# EasyEDA Pro project FPGA-G1.eprj, board logi Pi (continued)
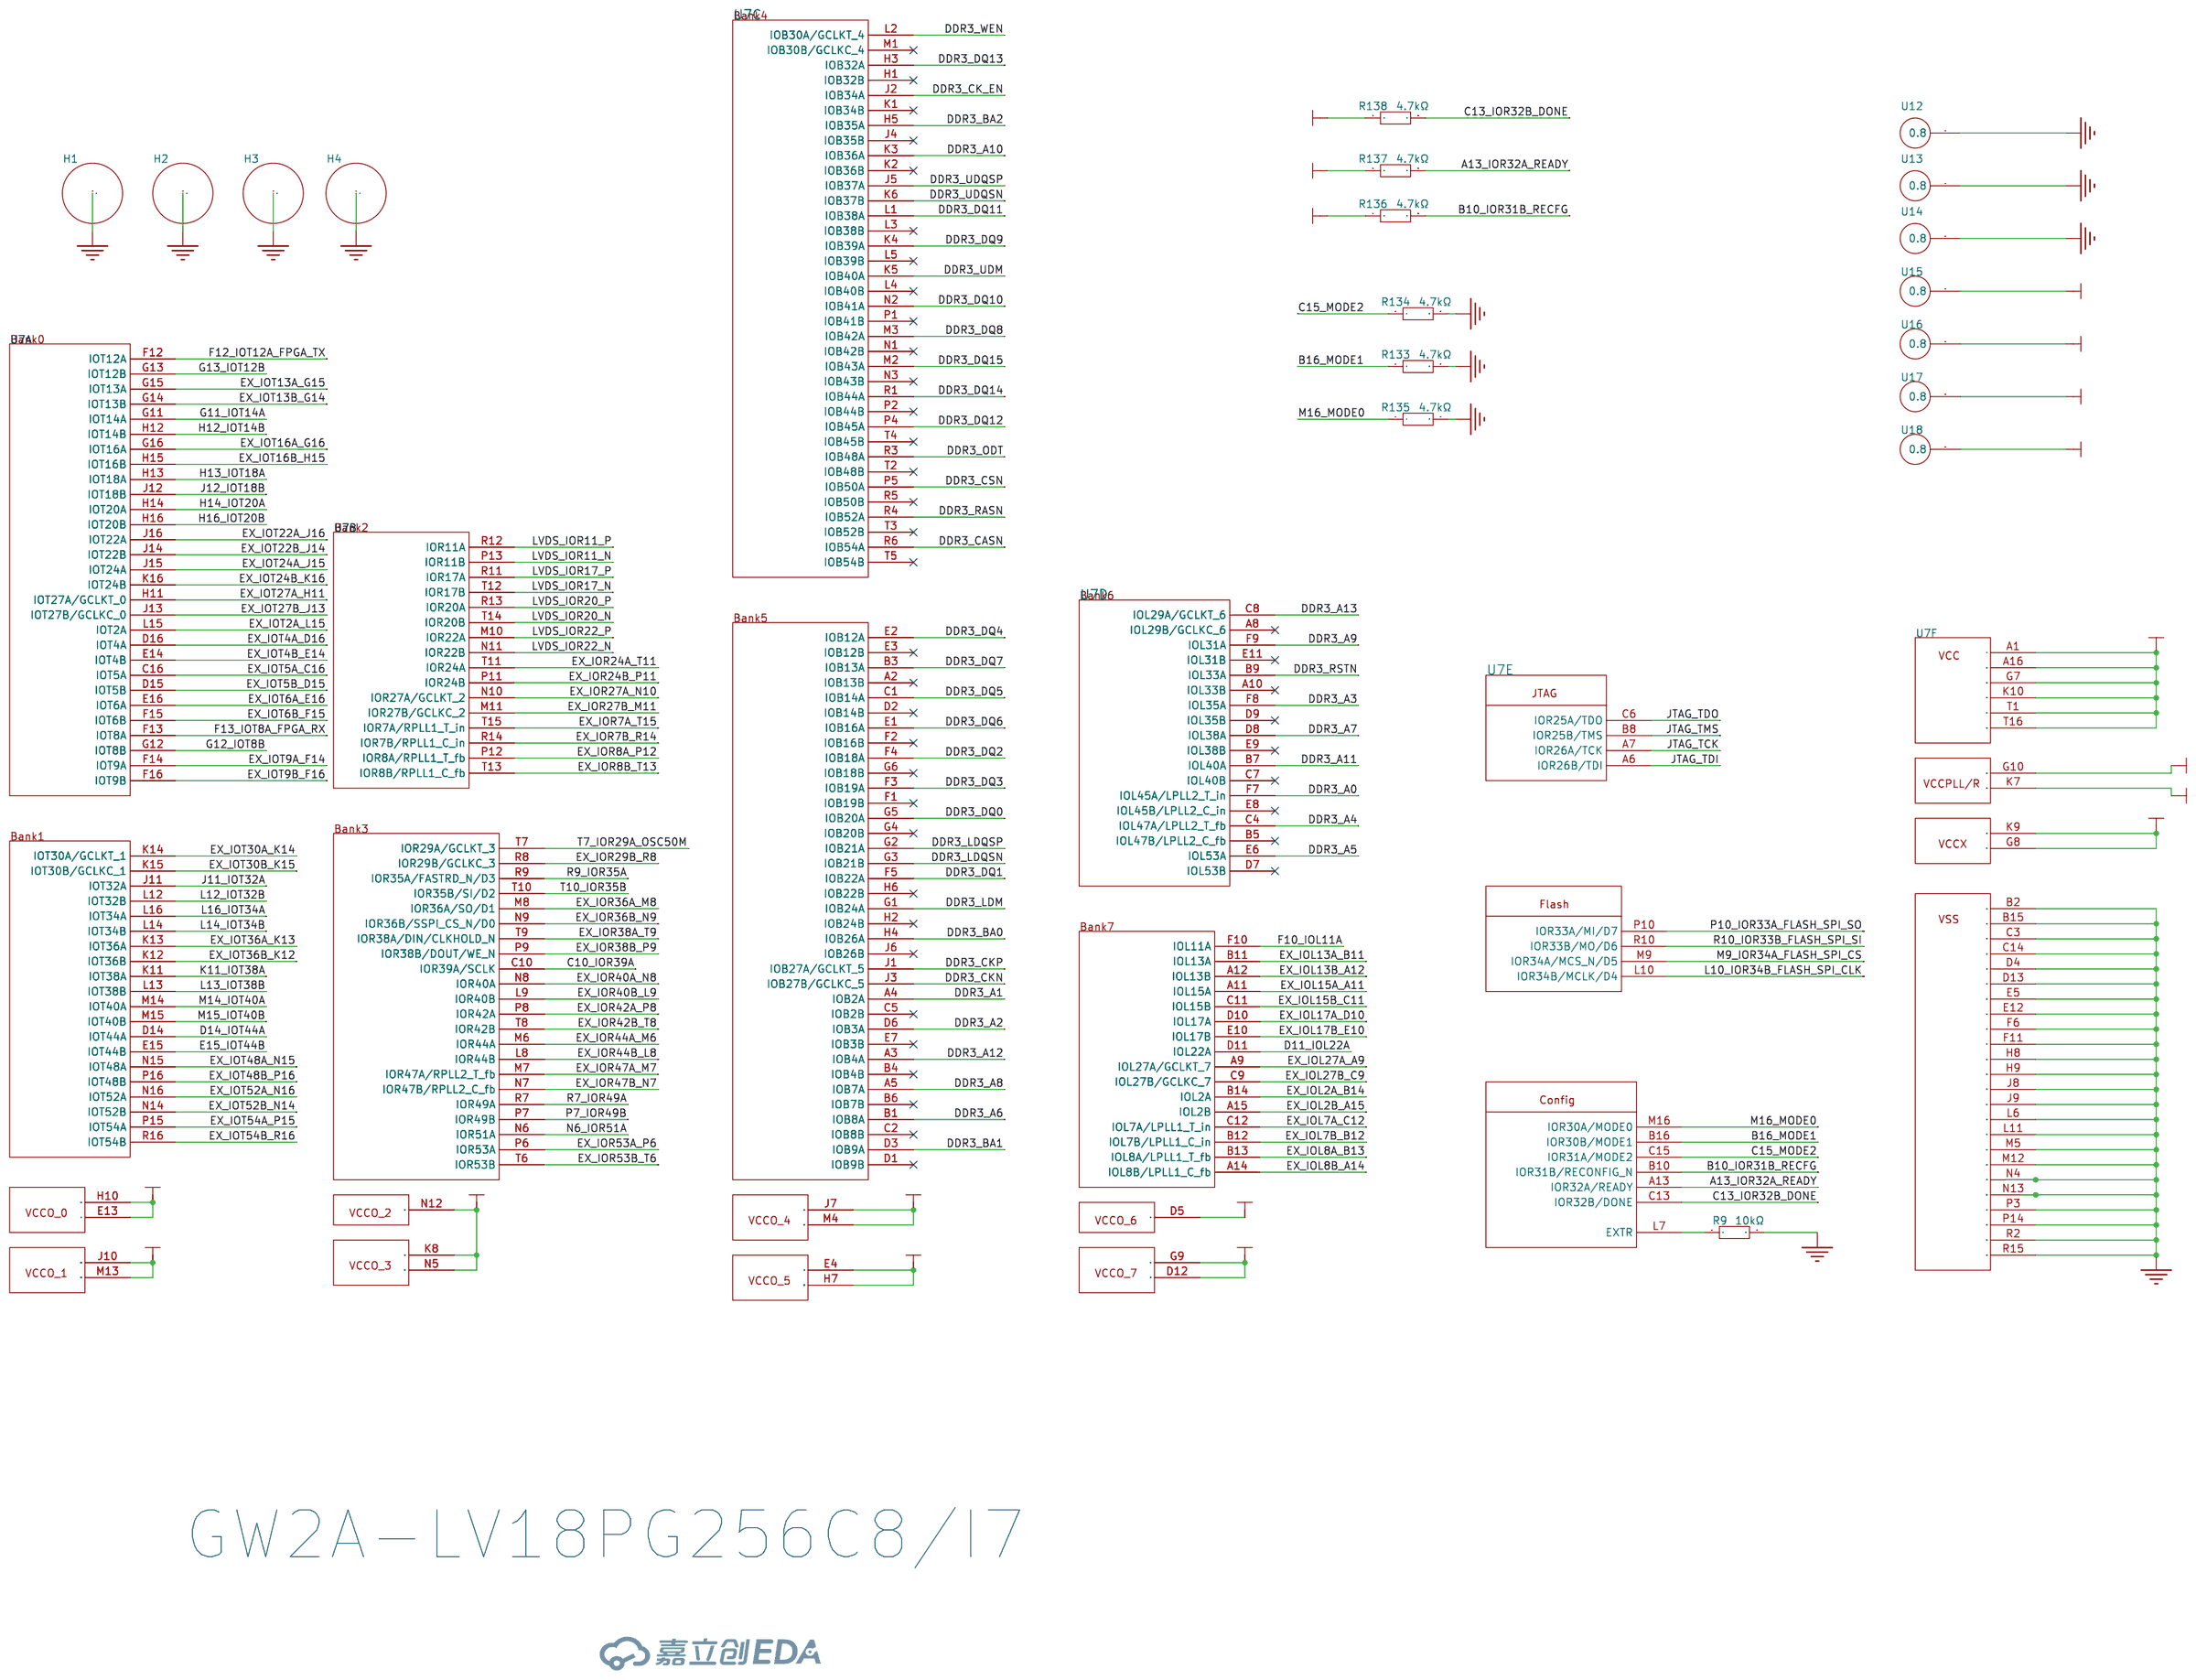
[diagram p0: FPGA]
## Routing (per net, layer and track width the routed paths; a pad name or vN(x,y) marks a point on that pad's centre or on a via; arc(x,y) is an arc through that point) (continued)
P10_IOR33A_FLASH_SPI_SO: length 9.8
  Top Layer w0.109: 28.33,23.89 27.78,23.33 v1(27.22,23.33) ; 29.2,30.58 28.7,30.08
  Bottom Layer w0.109: v1(27.22,23.33) 27.84,23.33 28.18,23.68 28.18,29.19 28.71,29.71 v1(28.71,30.08)
PA8: length 75.1
  Top Layer w0.109: 32.42,18.63 33.29,18.63 33.69,18.23 ; 30.92,59.83 30.84,59.76 30.84,58.91 v1(31.08,58.67) ; 33.62,13.88 33.26,14.24 32.37,14.24 ; 32.33,14.24 31.97,14.24 31.66,14.55 31.66,16.25 31.84,16.43 ; 32.33,16.46 31.88,16.46 31.84,16.43 ; 31.84,16.43 31.81,16.43 31.65,16.58 31.65,18.45 31.84,18.64 32.25,18.64 ; C172.2 37.62,16.46 38.1,15.98 42.24,15.98 42.78,16.51 42.78,18.22 v1(42.33,18.66)
  SIG04 w0.109: v1(42.33,18.66) 42.33,18.75 43.02,19.44 43.02,25.78 44.19,26.94 44.19,34.95 42.83,36.31 42.83,56.29 42.19,56.93 38.08,56.93 37.3,57.71 32.05,57.71 v1(31.08,58.67)
PA9/USART0_TX: length 6.3
  Top Layer w0.109: 30.33,59.96 v1(30.33,59.29)
  Bottom Layer w0.109: v1(30.33,59.29) 30.33,63.06 29.1,64.29 28.94,64.29
PA10/USART0_RX: length 7.7
  Top Layer w0.109: 29.78,59.91 29.78,59.22 v1(30.33,58.67)
  Bottom Layer w0.109: 30.03,64.38 30.83,63.58 30.83,59.17 v1(30.33,58.67)
PA13/SWDIO: length 15.5
  Top Layer w0.109: 28.35,59.86 28.35,59.41 28.12,59.19 26.9,59.19 26.69,59.4 26.69,61.95 26.56,62.08 25.85,62.08
  Bottom Layer w0.109: 31.96,64.91 31.96,65.97 31.49,66.44 28.45,66.44 27.13,65.12 27.13,63.89 v1(25.82,62.57)
PA14/SWCLK: length 15.5
  Top Layer w0.109: 26.11,60.52 26.19,60.6 26.47,60.31 26.47,59.11 26.31,58.94
  Bottom Layer w0.109: 25.75,61.28 25.25,61.79 25.25,63.95 28.26,66.96 32.47,66.96 33.14,66.3 33.14,65.04
  vias: v1(25.82,61.27)
PA15/SPI2_NSS: length 28.1
  Top Layer w0.109: 25.25,58.45 25.19,58.51 18.05,58.51 15.28,55.74 13.2,55.74 12.24,54.78 12.24,50.46 12.67,50.02 13.98,50.02 14.31,50.36
  Bottom Layer w0.109: 18.15,54.53 18.15,53.73 17.38,52.96 15.45,52.96 ; 14.41,50.36 15.26,50.36 15.46,50.56 15.46,51.71 15.46,51.72 ; 15.44,52.63 15.44,51.96 15.45,51.95
  vias: v1(14.42,50.4)
PB3/SPI2_SCK: length 27.7
  Top Layer w0.109: 25.45,57.95 24.51,57.95 24.32,58.15 18.26,58.15 15.17,55.06 14.66,55.06 14.59,55.13 14.59,55.3 14.51,55.38 14.34,55.38 14.26,55.3 14.26,55.13 14.18,55.06 14.01,55.06 13.93,55.13 13.93,55.3 13.85,55.38 13.68,55.38 13.6,55.3 13.6,55.13 13.53,55.06 12.98,55.06 12.72,54.8 12.72,54.47 12.8,54.39 13.12,54.39 13.19,54.31 13.19,54.14 13.12,54.06 12.8,54.06 12.72,53.99 12.72,53.81 12.8,53.74 13.12,53.74 13.19,53.66 13.19,53.49 13.12,53.41 12.8,53.41 12.72,53.33 12.72,53.16 12.8,53.08 13.12,53.08 13.19,53 13.19,52.83 13.12,52.75 12.8,52.75 12.72,52.68 12.72,52.5 12.8,52.43 13.12,52.43 13.19,52.35 13.19,52.18 13.12,52.1 12.8,52.1 12.72,52.02 12.72,51.85 12.8,51.77 13.12,51.77 13.19,51.69 13.19,51.52 13.12,51.44 12.8,51.44 12.72,51.37 12.72,50.74 13.05,50.41 v1(13.44,50.41)
  Bottom Layer w0.109: 13.93,52.58 13.93,51.94 13.96,51.91 ; 13.92,51.65 13.92,50.89 v1(13.44,50.41) ; 13.92,52.89 13.93,52.9 13.93,53.14 14.71,53.92 14.71,54.32
PB4/SPI2_MISO: length 27.5
  Top Layer w0.109: 25.43,57.47 24.35,57.47 24.06,57.76 18.6,57.76 15.41,54.56 13.86,54.56 13.55,54.26 13.55,53.87 13.63,53.8 14.45,53.8 14.52,53.72 14.52,53.54 14.45,53.47 13.63,53.47 13.55,53.39 13.55,53.22 13.63,53.14 14.45,53.14 14.52,53.06 14.52,52.89 14.45,52.81 13.63,52.81 13.55,52.74 13.55,52.56 13.63,52.48 14.45,52.48 14.52,52.41 14.52,52.23 14.45,52.16 13.63,52.16 13.55,52.08 13.55,51.91 13.63,51.83 14.45,51.83 14.52,51.75 14.52,51.58 14.45,51.5 13.63,51.5 13.55,51.42 13.55,51.21 v1(13.43,51.08)
  Bottom Layer w0.109: 13.43,52.57 13.43,51.8 ; 13.42,51.8 13.44,51.78 ; 13.4,52.57 13.44,52.61 13.44,53.12 12.66,53.89 12.66,54.42 ; 13.44,51.68 13.43,51.66 13.43,50.94
PB5/SPI2_MOSI: length 27.1
  Top Layer w0.109: v1(15.07,51.08) 15.46,51.47 15.46,51.64 15.53,51.72 16.43,51.72 16.51,51.8 16.51,51.97 16.43,52.05 15.53,52.05 15.46,52.13 15.46,52.3 15.53,52.38 16.79,52.38 16.87,52.45 16.87,52.63 16.79,52.7 15.53,52.7 15.46,52.78 15.46,52.95 15.53,53.03 16.79,53.03 16.87,53.11 16.87,53.28 16.79,53.36 15.53,53.36 15.46,53.44 15.46,54.04 18.74,57.32 24.03,57.32 24.22,57.14 24.81,57.14 24.98,56.96 U1.41
  Bottom Layer w0.109: v1(15.07,51.08) 14.94,51.22 14.94,51.72 ; 14.94,52.6 14.94,52 14.95,51.99 ; 17.03,54.55 17.03,53.81 ; 17.03,53.81 16.59,53.36 15.07,53.36 14.94,53.23 14.94,52.71 ; 17.03,53.81 17.03,53.8
PB6: length 1.5
  Top Layer w0.203: 23.88,56.61 23.92,56.65 24.44,56.65 24.64,56.46 25.31,56.46
PB7: length 1.4
  Top Layer w0.203: 25.22,55.93 24.47,55.93 24.32,55.78 R167.1
PB8: length 1.8
  Top Layer w0.203: 23.79,54.95 23.8,54.96 25.56,54.96 25.57,54.95
R7_IOR49A: length 12.3
  Top Layer w0.109: 16.45,25.21 v1(16.45,25.64) ; U7.R7 v1(25.7,29.09)
  SIG04 w0.109: v1(16.45,25.64) 18.2,27.39 24.75,27.39 25.7,28.34 v1(25.7,29.09)
R9_IOR35A: length 15.2
  Top Layer w0.109: R170.1 18.34,25.94 18.71,26.31 v1(20.1,26.31) ; 28.72,29.1 28.22,29.6
  SIG04 w0.109: v1(28.72,29.11) 28.63,29.11 27.65,28.12 27.65,25.96 27.4,25.71 27.4,25.7 27.24,25.54 20.87,25.54 v1(20.1,26.31)
R10_IOR33B_FLASH_SPI_SI: length 12.3
  Top Layer w0.109: U7.R10 29.25,29.59 v1(29.73,29.12) ; 33.62,20.74 34.16,21.28 34.56,21.28
  Bottom Layer w0.109: 33.62,20.74 29.68,24.68 29.68,27.22 29.23,27.68 29.23,28.61 v1(29.73,29.12)
  vias: v1(33.66,20.74)
T7_IOR29A_OSC50M: length 2.4
  Top Layer w0.254: 26.24,28.6 25.55,27.91 25.55,26.46
T10_IOR35B: length 12.1
  Top Layer w0.109: U7.T10 29.2,27.79 28.72,27.31 ; 20.1,25.26 v1(20.1,25.64)
  SIG04 w0.109: 28.72,27.31 28.72,26.44 27.43,25.15 20.6,25.15 v1(20.1,25.64)
  vias: v1(28.72,27.33)
VREF_DRAM: length 29.9
  Top Layer w0.254: 10.74,23.76 10.13,23.76
  Top Layer w0.381: 9.49,25.06 9.48,25.04 9.48,24.45 ; 10.13,23.76 9.5,24.38 ; U29.M8 v1(10.3,37.84) ; v1(16.7,33.89) 16.35,34.24 U29.H1
  Bottom Layer w0.381: C89.1 16.94,34.12 v1(16.7,33.89) 16.14,34.45 14.44,34.45 13.79,33.8 12.94,33.8 12.15,34.58 12.15,37.36 11.65,37.87 10.33,37.87 v1(10.3,37.84) ; 10.31,37.78 10.09,37.56 10.08,37.56 9.78,37.26 9.78,37.25 9.56,37.03 8.31,37.03 C88.1 7.94,37.04 7.41,36.51 7.41,27.15 v1(9.49,25.07)
VTT_DRAM: length 5.5
  Bottom Layer w0.381: R117.2 8.12,43.87 7.66,43.87 7.39,43.6 7.39,41.08 R119.2
  Bottom Layer w0.508: R125.1 R119.2
  vias: v1(7.84,45.91) v1(7.84,45.29) v1(10.62,26.74) v1(11.29,26.74)
$1N2157: length 0.7
  Top Layer w0.109: U7.L7 v1(25.7,33.09)
$2N2162: length 3.9
  Top Layer w0.109: R132.2 8.8,35.59 8.91,35.7 8.91,36.76 9.19,37.05 10.19,37.05 10.55,36.68
$3N1163: length 2.7
  Top Layer w0.381: 14.81,21.03 14.87,20.96 14.87,19.9 14.38,19.4 13.59,19.4
$3N1169: length 4
  Top Layer w0.254: 13.52,20.34 13.77,20.34 14.05,20.62 14.05,21.46 13.76,21.74 U23.1
  Top Layer w0.381: R76.2 12.46,20.34 13.52,20.34 ; 12.3,19.91 12.27,19.94 12.27,20.54
$3N1170: length 1.4
  Top Layer w0.254: 10.73,22.25 9.74,22.25 R74.2
$3N1171: length 1.3
  Top Layer w0.254: 10.71,23.24 9.47,23.24 9.4,23.32
$3N1172: length 1.3
  Top Layer w0.254: 8.56,21.74 8.59,21.77 8.59,22.46 ; 8.59,22.65 8.59,23.19 8.54,23.24
$4N1091: length 3.4
  Top Layer w0.109: U20.3 17.52,64.75 17.52,63.83 18.45,62.9 R18.1
$4N1092: length 3.4
  Top Layer w0.109: U20.2 18.51,63.67 19.38,62.81 19.38,61.73 R19.1
$4N1100: length 2
  Top Layer w0.254: 25.56,25.53 25.56,23.96 25.28,23.68
$4N1105: length 2.7
  Top Layer w0.109: v1(30.02,22.61) 30.02,22.61 28.4,22.61
  Bottom Layer w0.109: 28.94,22.62 29.94,22.62 29.98,22.66
$4N1112: length 0.8
  Top Layer w0.109: 37.06,23.35 36.98,23.35 36.45,23.87
$4N1119: length 4.4
  Top Layer w0.508: 23.36,21.92 23.46,21.83 23.46,21.03 24.01,20.48 25.05,20.48 25.09,20.43 ; 23.28,23.47 23.28,21.91
$4N1123: length 1.1
  Top Layer w0.254: LED4.2 9.29,66.3 R176.1
$5N1099: length 6.2
  Top Layer w0.109: 10.55,6.22 10.55,6.23 10.07,6.7 10.07,7.34 9.93,7.49 7.52,7.49 6.94,8.07 R152.1
$5N1100: length 4.5
  Top Layer w0.109: R153.1 7.79,9.07 8.59,8.27 10.46,8.27 10.75,7.99 10.75,7.44
$5N1108: length 3.4
  Top Layer w0.109: USB3.1 13.94,7.89 14.02,7.98 14.74,7.98 16.02,9.26 16.02,9.54
$5N1109: length 4.3
  Top Layer w0.109: R154.1 8.62,8.75 8.88,8.48 10.79,8.48 11.15,8.12 11.15,7.44
$6N914: length 19.7
  Top Layer w0.109: 16.32,57.9 15.16,56.74 13.58,56.74 11.72,54.88 11.72,50.41 12.44,49.69 16.6,49.69 16.87,49.95 16.87,51.96 17.28,52.38 18.49,52.38
$6N915: length 18.9
  Top Layer w0.109: 12.37,49.46 12.44,49.43 16.73,49.43 17.12,49.81 17.12,51.67 17.3,51.85 18.61,51.85 RN4.7 ; 12.37,49.46 12.41,49.43 ; 12.37,49.46 11.47,50.36 11.47,55.29 13.21,57.02 13.85,57.02 14.69,57.86
$6N916: length 17.6
  Top Layer w0.109: 12.24,49.26 11.23,50.27 11.23,55.69 11.8,56.26 11.8,58 ; 12.24,49.26 12.33,49.19 16.61,49.19 16.61,49.2 16.79,49.2 16.79,49.19 16.81,49.19 17.38,49.76 17.38,51.17 17.58,51.36 18.6,51.36 RN4.6 ; 12.24,49.26 12.31,49.19
$6N917: length 17.9
  Top Layer w0.109: 10.27,58.26 10.27,56.43 10.98,55.72 10.98,50.2 12.2,48.98 17,48.98 17.62,49.61 17.62,50.65 17.83,50.86 18.61,50.86 RN4.5
$6N918: length 3.5
  Top Layer w0.109: RN5.1 18.12,48.36 17.87,48.11 16.45,48.11 16.29,47.95 16.29,46.91
$6N919: length 5.5
  Top Layer w0.109: LED6.4 14.81,47.8 15.35,48.33 17.57,48.33 18.1,48.86 RN5.2
$6N920: length 8.3
  Top Layer w0.109: 11.79,47.23 11.79,48.28 12.05,48.55 17.24,48.55 18.04,49.35 18.61,49.35 RN5.3
$6N921: length 10.3
  Top Layer w0.109: RN5.4 18.18,49.86 17.08,48.76 10.84,48.76 10.26,48.18 10.26,46.98
$6N938: length 3.1
  Top Layer w0.109: 18.56,22 18.99,22 19.15,22.16 19.15,23.46 18.41,24.2 R170.2 ; 18.34,24.29 18.34,24.25
$6N939: length 1.4
  Top Layer w0.109: 16.46,24.28 16.48,24.27 ; 16.48,24.27 16.48,24.4 ; 16.48,24.27 16.48,24.14 16.74,23.88 16.74,23.48 16.95,23.26
$6N940: length 3.1
  Top Layer w0.109: 17.27,22.04 17.3,22.01 17.65,22.01 17.86,22.23 17.86,23.69 17.4,24.16 17.4,24.41
$6N948: length 2.8
  Top Layer w0.109: 21.08,22.02 20.77,22.02 20.61,22.17 20.61,23.86 20.95,24.2 R173.2
$6N949: length 1.4
  Top Layer w0.109: LED3.1 19.75,23.61 19.21,24.14 R174.1
$6N950: length 2.9
  Top Layer w0.109: 20.14,24.31 20.14,24.18 ; 20.14,24.18 20.14,24.13 20.38,23.88 20.38,22.17 20.23,22.02 19.84,22.02 ; 20.14,24.18 20.1,24.18
$7N2275: length 1.4
  Top Layer w0.109: FPC1.9 30.03,63.26 R7.1
$7N2276: length 8.4
  Top Layer w0.254: 30.53,64.01 30.53,64.02 30.53,64.95 30.67,65.09 30.89,65.09 31.03,64.94 FPC1.7 ; 31.04,63.69 31.04,63.19 31.17,63.05 31.84,63.05 32.04,63.25 ; v1(33.68,62.59) 33.2,63.07 32.22,63.07 32.04,63.25 ; 31.52,63.6 31.52,63.06 ; 32.04,63.25 32.03,63.26 FPC1.5
  Bottom Layer w0.254: Q1.3 34.48,62.59 v1(33.68,62.59)
$7N2277: length 3.1
  Bottom Layer w0.254: 34.49,57.83 34.49,58.37 34.53,58.42 ; 35.49,60.47 35.13,60.47 34.49,59.84 34.49,58.6
$7N2346: length 1.1
  Top Layer w0.203: 22.77,55.66 22.23,55.13 21.85,55.13
$7N2347: length 5.1
  Top Layer w0.203: 22.81,54.75 22.41,54.35 20.09,54.35 19.76,54.68 19.76,55.58 20.35,56.17
$7N2348: length 4.1
  Top Layer w0.203: 22.91,56.7 22.67,56.94 21.31,56.94 21.11,56.74 21.11,55.37 20.92,55.19 20.45,55.19
$10N4043: length 1.9
  Top Layer w0.109: 33.65,7.46 33.67,7.48 33.67,9.36
$10N4048: length 3.2
  Top Layer w0.109: 30.62,7.03 30.69,7.1 30.69,8.65 30.56,8.78 30.17,8.78 29.83,9.12 29.83,9.46 29.72,9.57
$10N4103: length 1.5
  Top Layer w0.508: C176.2 17.44,2.95 U2.1
$10N4104: length 1.2
  Top Layer w0.381: C176.1 16.74,4.99
$10N4105: length 2.6
  Top Layer w0.381: U2.3 19.54,2.07 C177.1 ; R40.2 19.54,1.36
  Bottom Layer w0.381: R37.1 v1(19.01,1.35)
$10N4110: length 5.1
  Top Layer w0.381: R156.2 20.86,4.41 20.47,4.81 U2.4 19.99,4.92 v1(19.99,5.64)
  Bottom Layer w0.381: C175.2 R36.1 20.38,4.82 19.99,5.2 v1(19.99,5.64)
$10N4116: length 1.5
  Top Layer w0.508: U31.1 19.14,14.94 C183.2
$10N4117: length 1
  Top Layer w0.381: C183.1 17.31,14.24
$10N4118: length 2.7
  Top Layer w0.381: 20.72,16.1 20.72,17.04 ; U31.3 20.01,17.04 C184.1
  Bottom Layer w0.381: R166.1 v1(20.72,16.44)
$10N4123: length 5.1
  Top Layer w0.381: v1(16.44,17.49) 17.16,17.49 U31.4 17.28,17.97 17.67,18.36 R158.2
  Bottom Layer w0.381: C182.2 R157.1 17.25,17.82 16.93,17.49 v1(16.44,17.49)
$10N4129: length 1.2
  Top Layer w0.381: U32.1 22.68,2.88 C190.2
$10N4130: length 1
  Top Layer w0.381: 22.23,3.75 22.23,4.78
$10N4131: length 2.6
  Top Layer w0.381: R164.2 24.77,1.36 24.77,2.01 25.11,2.34
  Bottom Layer w0.381: R163.1 v1(24.23,1.32)
$10N4136: length 4.9
  Top Layer w0.381: v1(25.27,5.55) 25.27,4.9 25.11,4.75 25.79,4.75 26.12,4.42 26.12,3.77 26.09,3.75
  Bottom Layer w0.381: R162.2 26.07,4.82 R161.1 25.54,4.84 25.27,5.11 v1(25.27,5.55)

## Copper pours and planes (outline as drawn; the poured copper is in the pictures)
+1.0V on Top Layer: 23.27,12.58 28.12,12.58 28.12,10.04 23.27,10.04
+1.0V on Bottom Layer: 26.6,11.79 26.6,12.13 25.36,12.13 24.72,12.77 24.72,18.17 18.15,24.73 18.15,26.95 19.53,28.32 20.19,28.32 20.3,28.22 20.3,28.06 27.37,20.99 27.37,15.02 27.58,14.71 28.97,14.71 34.24,19.98 34.24,27.9 35.35,29.01 36.46,29.01 37.01,28.45 37.01,18.43 30.12,11.54 26.86,11.54
+1.0V on Bottom Layer: 28.39,35.33 31.24,38.24 31.24,39.16 31.83,39.75 32.6,39.75 32.6,45.14 32.41,44.94 31.88,44.94 30.01,46.81 28.95,46.81 28.37,46.23 28.37,39.59 27.54,38.61 26.41,38.61 26.23,38.43 26.23,36.83 25.61,36.21 25,36.21 24.45,36.76 24.45,36.93 24.88,37.36 24.88,38.06 25.21,38.39 25.21,42.56 24.66,43.11 19.77,43.11 19.1,43.78 19.1,46.14 19.51,46.54 20.9,46.54 22.95,44.49 25.11,44.49 25.74,45.13 25.74,48.27 26.68,49.2 33.11,49.2 33.6,48.71 33.6,45.82 34.07,45.24 36.2,45.24 36.3,45.13 36.3,41.18 33.18,38.06 33.18,37.03 33.7,36.51 36.78,36.51 37.83,35.46 37.83,28.39 37.53,28.09 35.26,28.09 34.65,28.7 34.65,33.07 34.21,33.52 28.97,33.52 28.39,34.09
+1.0V on Bottom Layer: 24.88,12.71 27.45,12.71 27.45,9.85 24.88,9.85
+1.5V on Top Layer: 7.49,19.34 11.37,19.34 11.37,15.32 7.49,15.32
+1.5V on Top Layer: 15.76,21.52 17.37,21.52 17.37,20.22 15.76,20.22
+1.5V on Bottom Layer: 8.2,19.17 9.68,19.17 9.68,17.15 8.2,17.15
+1.5V on POWER05: 3.03,44.16 2.33,43.46 2.33,17.58 3.26,16.65 17,16.65 17.51,17.2 17.51,22.21 20.52,29.27 30.81,39.08 30.81,44.36 26.28,48.89 14.9,48.89 10.09,44.08 3.1,44.08
+3.3V on Top Layer: 19.39,13.9 22.07,13.9 22.07,7.08 19.39,7.08
+3.3V on Top Layer: 7.53,20.81 9.14,20.81 9.14,19.51 7.53,19.51
+3.3V on Bottom Layer: 18.93,14.84 22.24,14.84 22.24,11.51 18.93,11.51
+3.3V on Bottom Layer: 5.25,16.23 4.69,15.67 4.69,14.07 5.15,13.61 6.78,13.61 9,15.83 9,20.83 8.75,21.08 7.41,21.08 7.14,20.81 7.14,16.73 6.64,16.23
+3.3V on POWER05: -2.99,71.47 -2.99,-0.39 -0.51,-2.87 47.07,-2.87 49.4,-0.54 49.4,68.46 44.89,72.97 -1.49,72.97
+3.3V on POWER05: 26.43,39.05 26.69,39.32 30.25,39.32 31.88,41.83 32.75,30 31.75,29 22.89,29 22.05,29.83 22.05,30.37 26.43,34.71
+5V_IN on Top Layer: 29.69,6.43 34.2,6.43 34.2,5.72 29.69,5.72
+5V_IN on Top Layer: 18.41,6.66 19.51,6.66 19.51,4.34 18.41,4.34
+5V_IN on Top Layer: 23.64,6.6 24.74,6.6 24.74,4.28 23.64,4.28
+5V_IN on Top Layer: 8.66,64.14 12.78,64.14 12.78,61.91 8.66,61.91
+5V_IN on Top Layer: 35.27,64.8 36.42,64.8 36.42,62.5 35.27,62.5
+5V_IN on Top Layer: 15.58,17.02 17.74,17.02 17.74,15.9 15.58,15.9
+5V_IN on Bottom Layer: 42.65,60.74 44.71,60.74 44.71,58.44 42.65,58.44
+5V_IN on Bottom Layer: 21.95,6.73 24.93,6.73 24.93,4.04 21.95,4.04
+5V_IN on Bottom Layer: 16.69,6.78 19.66,6.78 19.66,4.1 16.69,4.1
+5V_IN on Bottom Layer: 3.67,13.38 7.1,13.38 7.1,9.08 3.67,9.08
+5V_IN on Bottom Layer: 28.67,13.34 42.57,13.34 42.57,5.77 28.67,5.77
+5V_IN on Bottom Layer: 15.48,17.1 17.97,17.1 17.97,14.13 15.48,14.13
+5V_IN on Bottom Layer: 36.44,65.28 36.43,64.15 38.33,62.26 38.33,61.84 38.31,61.82 38.06,61.82 37.67,61.43 37.32,61.43 35.64,63.11 35.64,63.3 35.33,63.3 35.16,63.47 35.16,63.78 34.97,63.93 33.69,63.94 33.55,64.07 33.54,65.39 33.71,65.5 36.19,65.49
+5V_IN on SIG04: 1.89,13.72 -0.47,11.36 -0.36,1.68 1.44,-0.12 44.43,-0.12 45.64,1.09 45.64,12.27 44.15,13.76 34.33,13.76 33.43,12.86 24.22,12.86 19.09,18.81 13.65,18.81 8.57,13.72
+5V_IN on SIG04: 8.31,64.8 8.31,62.1 8.64,61.77 35.97,61.77 37.2,60.54 37.2,58.06 38.58,56.68 42.56,56.68 43.61,57.73 43.61,62.53 39.28,66.86 10.37,66.86
GND on Top Layer: 18,17.72 20.08,17.72 20.08,16.11 18,16.11
GND on Top Layer: 7.49,16.36 9.66,16.36 9.66,14.25 7.49,14.25
GND on Top Layer: 8.56,61.7 12.47,61.7 12.47,59.95 8.56,59.95
GND on Top Layer: 18.61,4.08 20.22,4.08 20.22,2.01 18.61,2.01
GND on Top Layer: 11.27,26.33 13.21,26.33 13.21,21.68 11.27,21.68
GND on Top Layer: 16.62,13.63 19.14,13.63 19.14,10.47 16.62,10.47
GND on Top Layer: 9.29,23.8 12.69,23.8 12.69,19.25 9.29,19.25
GND on Top Layer: 23.87,4.02 25.48,4.02 25.48,1.94 23.87,1.94
GND on Bottom Layer: 21.87,12.73 24.45,12.73 24.45,10.06 21.87,10.06
GND on GND02: -5.55,75.57 54.68,75.57 54.68,-7.73 -5.55,-7.73
HDMI_5V on Bottom Layer: 6.23,10.18 9.25,10.18 9.25,7.51 6.23,7.51
VTT_DRAM on Top Layer: 10.18,27.21 14.79,27.21 14.79,22.58 10.18,22.58
VTT_DRAM on Top Layer: 7.53,46.06 16.3,46.06 16.3,43.46 7.53,43.46
VTT_DRAM on Bottom Layer: 7.4,46.17 18.01,46.17 18.01,43.4 7.4,43.4
VTT_DRAM on SIG04: 9.54,27.39 11.18,27.39 11.82,26.75 11.82,20.78 9.71,18.67 2.33,18.67 1.49,19.51 1.7,51.34 2.34,51.92 8.5,51.92 9,51.37 9,46.03 6.87,43.96 2.76,43.96 2.36,43.56 2.36,26.86 3.06,26.16 8.31,26.16
$3N1163 on Top Layer: 13.16,23.38 15.34,23.38 15.34,20.45 13.16,20.45
$3N1172 on Top Layer: 8.15,21.93 11.05,21.93 11.05,20.99 8.15,20.99
$10N4104 on Top Layer: 16.44,9.5 18.31,9.5 18.31,4.31 16.44,4.31
$10N4117 on Top Layer: 13.77,17.84 17.87,17.84 17.87,13.93 13.77,13.93
$10N4130 on Top Layer: 21.92,8.43 25.55,8.43 25.55,4.15 21.92,4.15

## Text on the board
Document Layer: HDMI | USB | RESET | BOOT | JTAG下载口 | TFT 屏座子 | 按键 | TF 卡座子 | DPLINK下载口
